# EasyEDA Pro project 3SE_24_Power_Rune.eprj, board Armour (continued)
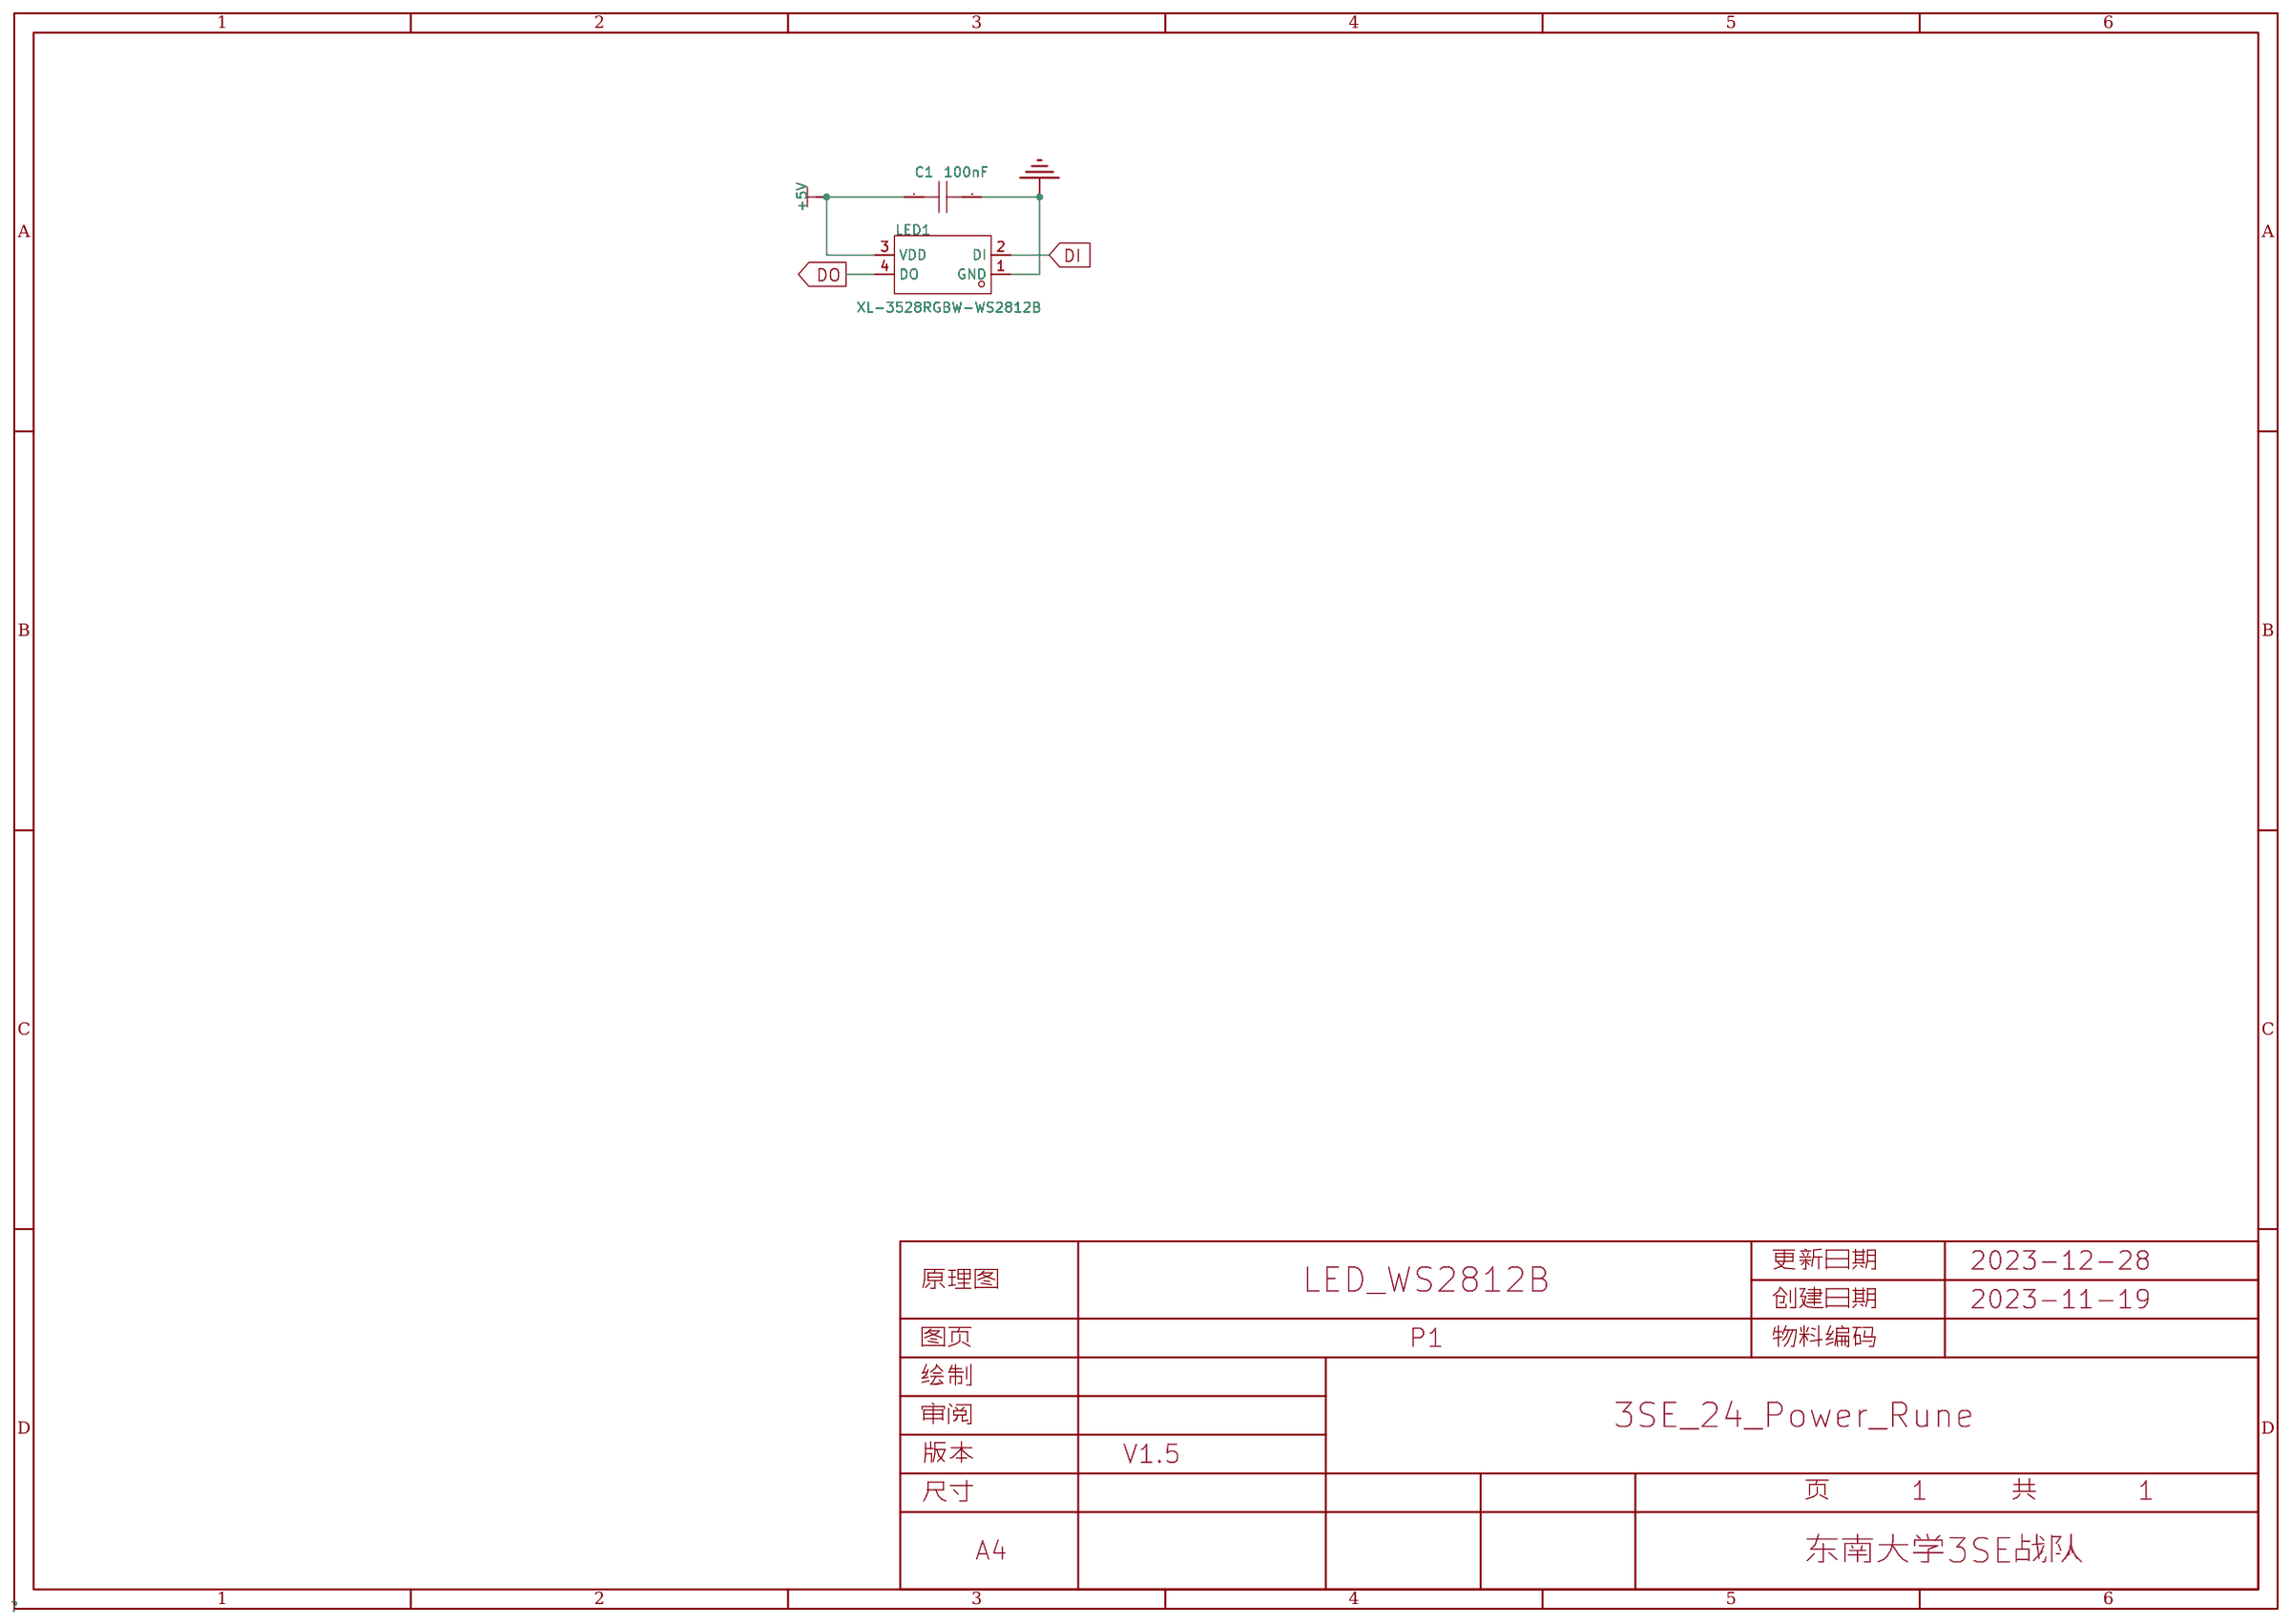
[diagram p0: schematic sheet]
## Placement (name value [footprint] x y rotation side) (continued)
C438  33nF  [C0603]  33.49 215.81 270 top
C439  100nF  [C0603]  331.91 201.18 270 top
C440  10uF  [C0603]  330.18 201.18 90 top
C441  100nF  [C0603]  352.22 233.9 180 top
C442  100nF  [C0603]  352.24 232.23 180 top
C443  100nF  [C0603]  279.05 249.36 0 top
C444  100nF  [C0603]  285.28 224.05 0 top
C445  1uF  [C0603]  328.78 234.88 90 top
C446  100nF  [C0603]  330.47 234.89 90 top
C447  100nF  [C0603]  248.04 239.71 0 top
C448  100nF  [C0603]  335.66 198 180 top
C449  100nF  [C0603]  247.69 235.59 90 top
C450  1uF  [C0603]  327.06 232.06 90 top
C451  100nF  [C0603]  225.74 219.96 0 top
C452  12pF  [C0603]  327.94 226.62 180 top
C453  100nF  [C0603]  213.56 205.44 0 top
C454  12pF  [C0603]  328.85 223.46 270 top
C456  100nF  [C0603]  212.46 187.33 0 top
C457  100nF  [C0603]  185.01 186.73 0 top
C458  -  [C0603]  48.33 77 108.9 top
C459  -  [C0603]  43.47 91.19 108.9 top
C460  -  [C0603]  38.61 105.38 108.9 top
C461  -  [C0603]  33.76 119.57 108.9 top
C462  -  [C0603]  28.9 133.77 108.9 top
C463  -  [C0603]  24.04 147.96 108.9 top
CN1  XT30PW-M  [CONN-TH_XT30PW-M]  24.01 241.31 270 top
CN2  SM03B-GHS-TB(LF)(SN)  [CONN-TH_SM03B-GHS-TB-LF-SN]  349.04 32.76 11 top
CN3  SM03B-GHS-TB(LF)(SN)  [CONN-TH_SM03B-GHS-TB-LF-SN#2]  22.46 32.76 349 top
CN4  HC-GH-2PWT  [CONN-SMD_2P-P1.25_HCTL_HC-GH-2PWTKK]  201.97 3.81 0 top
CN5  XT30PW-F  [CONN-TH_XT30PW-F-1]  185.75 9.26 0 top
CN6  WAFER-GH1.25-4PWB  [CONN-SMD_4P-P1.25_XUNPU_WAFER-GH1.25-4PWB]  350.11 249.29 90 top
D1  ESDBM24VD3  [SOD-323_L1.7-W1.3-LS2.6-BI]  32.75 242.05 270 top
D2  SB1045L  [TO-277_3P-L5.4-W4.0-LS6.5-TR]  33.78 222.79 0 top
D3  SMBJ6.0CA  [SMB_L4.6-W3.6-LS5.3-BI]  39.18 171.06 90 top
D4  USBLC6-2SC6  [SOT-23-6_L2.9-W1.6-P0.95-LS2.8-BL]  344 207.28 90 top
KEY1  -  [热插拔轴座]  185.75 196.24 0 top
KEY2  -  [热插拔轴座]  169.84 212.15 315 top
KEY3  -  [热插拔轴座]  201.66 180.33 135 top
KEY4  -  [热插拔轴座]  212.27 222.75 45 top
KEY5  -  [热插拔轴座]  159.23 222.75 135 top
KEY6  -  [热插拔轴座]  159.23 169.72 225 top
KEY7  -  [热插拔轴座]  212.27 169.72 315 top
KEY8  -  [热插拔轴座]  222.87 233.36 225 top
KEY9  -  [热插拔轴座]  148.63 233.36 315 top
KEY10  -  [热插拔轴座]  148.63 159.11 45 top
KEY11  -  [热插拔轴座]  222.87 159.11 135 top
KEY12  -  [热插拔轴座]  233.48 243.96 45 top
KEY13  -  [热插拔轴座]  138.02 243.96 135 top
KEY14  -  [热插拔轴座]  138.02 148.51 225 top
KEY15  -  [热插拔轴座]  233.48 148.51 315 top
KEY16  -  [热插拔轴座]  244.09 254.57 225 top
KEY17  -  [热插拔轴座]  127.41 254.57 315 top
KEY18  -  [热插拔轴座]  127.41 137.9 45 top
KEY19  -  [热插拔轴座]  244.09 137.9 135 top
KEY20  -  [热插拔轴座]  275.83 233.55 22.5 top
KEY21  -  [热插拔轴座]  223.06 286.31 67.5 top
KEY22  -  [热插拔轴座]  148.44 286.31 112.5 top
KEY23  -  [热插拔轴座]  95.67 233.55 157.5 top
KEY24  -  [热插拔轴座]  95.67 158.92 202.5 top
KEY25  -  [热插拔轴座]  148.44 106.16 247.5 top
KEY26  -  [热插拔轴座]  223.06 106.16 292.5 top
KEY27  -  [热插拔轴座]  275.83 158.92 337.5 top
KEY28  -  [热插拔轴座]  289.69 239.29 202.5 top
KEY29  -  [热插拔轴座]  228.8 300.17 247.5 top
KEY30  -  [热插拔轴座]  142.7 300.17 292.5 top
KEY31  -  [热插拔轴座]  81.81 239.29 337.5 top
KEY32  -  [热插拔轴座]  81.81 153.18 22.5 top
KEY33  -  [热插拔轴座]  142.7 92.3 67.5 top
KEY34  -  [热插拔轴座]  228.8 92.3 112.5 top
KEY35  -  [热插拔轴座]  289.69 153.18 157.5 top
KEY36  -  [热插拔轴座]  303.54 245.03 22.5 top
KEY37  -  [热插拔轴座]  234.54 314.03 67.5 top
KEY38  -  [热插拔轴座]  136.96 314.03 112.5 top
KEY39  -  [热插拔轴座]  67.89 245.03 157.5 top
KEY40  -  [热插拔轴座]  67.95 147.44 202.5 top
KEY41  -  [热插拔轴座]  136.96 78.44 247.5 top
KEY42  -  [热插拔轴座]  234.54 78.44 292.5 top
KEY43  -  [热插拔轴座]  303.54 147.44 337.5 top
KEY44  -  [热插拔轴座]  317.4 250.77 202.5 top
KEY45  -  [热插拔轴座]  240.28 327.89 247.5 top
KEY46  -  [热插拔轴座]  131.22 327.89 292.5 top
KEY47  -  [热插拔轴座]  54.1 250.77 337.5 top
KEY48  -  [热插拔轴座]  54.1 141.7 22.5 top
KEY49  -  [热插拔轴座]  131.22 64.58 67.5 top
KEY50  -  [热插拔轴座]  240.28 64.58 112.5 top
KEY51  -  [热插拔轴座]  317.4 141.7 157.5 top
L1  47uH  [IND-SMD_L17.5-W17.2]  28.94 188.5 0 top
LED1  -  [LED-SMD_4P-L3.5-W2.8-BR-1]  328.25 196.24 0 top
LED2  -  [LED-SMD_4P-L3.5-W2.8-BR-1]  327.03 214.84 0 top
LED3  -  [LED-SMD_4P-L3.5-W2.8-BR-1]  323.39 233.12 0 top
LED4  -  [LED-SMD_4P-L3.5-W2.8-BR-1]  309.16 267.49 0 top
LED5  -  [LED-SMD_4P-L3.5-W2.8-BR-1]  298.8 282.98 0 top
LED6  -  [LED-SMD_4P-L3.5-W2.8-BR-1]  286.51 297 0 top
LED7  -  [LED-SMD_4P-L3.5-W2.8-BR-1]  272.5 309.29 0 top
LED8  -  [LED-SMD_4P-L3.5-W2.8-BR-1]  257 319.64 0 top
LED9  -  [LED-SMD_4P-L3.5-W2.8-BR-1]  222.63 333.88 0 top
LED10  -  [LED-SMD_4P-L3.5-W2.8-BR-1]  204.35 337.52 0 top
LED11  -  [LED-SMD_4P-L3.5-W2.8-BR-1]  185.75 338.74 0 top
LED12  -  [LED-SMD_4P-L3.5-W2.8-BR-1]  167.15 337.52 0 top
LED13  -  [LED-SMD_4P-L3.5-W2.8-BR-1]  148.87 333.88 0 top
LED14  -  [LED-SMD_4P-L3.5-W2.8-BR-1]  114.5 319.64 0 top
LED15  -  [LED-SMD_4P-L3.5-W2.8-BR-1]  99 309.29 0 top
LED16  -  [LED-SMD_4P-L3.5-W2.8-BR-1]  84.99 297 0 top
LED17  -  [LED-SMD_4P-L3.5-W2.8-BR-1]  72.7 282.98 0 top
LED18  -  [LED-SMD_4P-L3.5-W2.8-BR-1]  62.34 267.49 0 top
LED19  -  [LED-SMD_4P-L3.5-W2.8-BR-1]  48.1 233.12 0 top
LED20  -  [LED-SMD_4P-L3.5-W2.8-BR-1]  44.47 214.84 0 top
LED21  -  [LED-SMD_4P-L3.5-W2.8-BR-1]  43.25 196.24 0 top
LED22  -  [LED-SMD_4P-L3.5-W2.8-BR-1]  44.47 177.64 0 top
LED23  -  [LED-SMD_4P-L3.5-W2.8-BR-1]  48.1 159.35 0 top
LED24  -  [LED-SMD_4P-L3.5-W2.8-BR-1]  62.34 124.99 0 top
LED25  -  [LED-SMD_4P-L3.5-W2.8-BR-1]  72.7 109.49 0 top
LED26  -  [LED-SMD_4P-L3.5-W2.8-BR-1]  84.99 95.47 0 top
LED27  -  [LED-SMD_4P-L3.5-W2.8-BR-1]  99 83.18 0 top
LED28  -  [LED-SMD_4P-L3.5-W2.8-BR-1]  114.5 72.83 0 top
LED29  -  [LED-SMD_4P-L3.5-W2.8-BR-1]  148.87 58.59 0 top
LED30  -  [LED-SMD_4P-L3.5-W2.8-BR-1]  167.15 54.95 0 top
LED31  -  [LED-SMD_4P-L3.5-W2.8-BR-1]  185.75 53.74 0 top
LED32  -  [LED-SMD_4P-L3.5-W2.8-BR-1]  204.35 54.95 0 top
LED33  -  [LED-SMD_4P-L3.5-W2.8-BR-1]  222.63 58.59 0 top
LED34  -  [LED-SMD_4P-L3.5-W2.8-BR-1]  257 72.83 0 top
LED35  -  [LED-SMD_4P-L3.5-W2.8-BR-1]  272.5 83.18 0 top
LED36  -  [LED-SMD_4P-L3.5-W2.8-BR-1]  286.51 95.47 0 top
LED37  -  [LED-SMD_4P-L3.5-W2.8-BR-1]  298.8 109.49 0 top
LED38  -  [LED-SMD_4P-L3.5-W2.8-BR-1]  309.16 124.99 0 top
LED39  -  [LED-SMD_4P-L3.5-W2.8-BR-1]  323.39 159.35 0 top
LED40  -  [LED-SMD_4P-L3.5-W2.8-BR-1]  327.03 177.64 0 top
LED41  -  [LED-SMD_4P-L3.5-W2.8-BR-1]  313.35 196.25 0 top
LED42  -  [LED-SMD_4P-L3.5-W2.8-BR-1]  311.97 214.01 180 top
LED43  -  [LED-SMD_4P-L3.5-W2.8-BR-1]  308.31 231.38 0 top
LED44  -  [LED-SMD_4P-L3.5-W2.8-BR-1]  299.4 253.98 0 top
LED45  -  [LED-SMD_4P-L3.5-W2.8-BR-1]  293.88 263.8 0 top
LED46  -  [LED-SMD_4P-L3.5-W2.8-BR-1]  283.42 278.19 0 top
LED47  -  [LED-SMD_4P-L3.5-W2.8-BR-1]  271.06 290.99 0 top
LED48  -  [LED-SMD_4P-L3.5-W2.8-BR-1]  257.05 301.94 0 top
LED49  -  [LED-SMD_4P-L3.5-W2.8-BR-1]  243.54 309.87 180 top
LED50  -  [LED-SMD_4P-L3.5-W2.8-BR-1]  225.28 317.49 0 top
LED51  -  [LED-SMD_4P-L3.5-W2.8-BR-1]  207.89 321.8 0 top
LED52  -  [LED-SMD_4P-L3.5-W2.8-BR-1]  190.2 323.66 0 top
LED53  -  [LED-SMD_4P-L3.5-W2.8-BR-1]  172.42 323.04 0 top
LED54  -  [LED-SMD_4P-L3.5-W2.8-BR-1]  154.22 319.34 0 top
LED55  -  [LED-SMD_4P-L3.5-W2.8-BR-1]  122 306.65 0 top
LED56  -  [LED-SMD_4P-L3.5-W2.8-BR-1]  107.25 296.71 0 top
LED57  -  [LED-SMD_4P-L3.5-W2.8-BR-1]  94.03 284.8 0 top
LED58  -  [LED-SMD_4P-L3.5-W2.8-BR-1]  82.6 271.18 0 top
LED59  -  [LED-SMD_4P-L3.5-W2.8-BR-1]  73.17 256.09 0 top
LED60  -  [LED-SMD_4P-L3.5-W2.8-BR-1]  64.73 236.35 180 top
LED61  -  [LED-SMD_4P-L3.5-W2.8-BR-1]  61.04 222.74 0 top
LED62  -  [LED-SMD_4P-L3.5-W2.8-BR-1]  58.56 205.13 0 top
LED63  -  [LED-SMD_4P-L3.5-W2.8-BR-1]  58.56 187.34 0 top
LED64  -  [LED-SMD_4P-L3.5-W2.8-BR-1]  61.04 169.73 0 top
LED65  -  [LED-SMD_4P-L3.5-W2.8-BR-1]  64.57 156.67 0 top
LED66  -  [LED-SMD_4P-L3.5-W2.8-BR-1]  73.17 136.38 0 top
LED67  -  [LED-SMD_4P-L3.5-W2.8-BR-1]  82.6 121.29 0 top
LED68  -  [LED-SMD_4P-L3.5-W2.8-BR-1]  94.03 107.67 0 top
LED69  -  [LED-SMD_4P-L3.5-W2.8-BR-1]  106.42 96.66 0 top
LED70  -  [LED-SMD_4P-L3.5-W2.8-BR-1]  122 85.82 0 top
LED71  -  [LED-SMD_4P-L3.5-W2.8-BR-1]  154.9 72.52 0 top
LED72  -  [LED-SMD_4P-L3.5-W2.8-BR-1]  172.42 69.43 0 top
LED73  -  [LED-SMD_4P-L3.5-W2.8-BR-1]  190.2 68.81 0 top
LED74  -  [LED-SMD_4P-L3.5-W2.8-BR-1]  207.89 70.67 0 top
LED75  -  [LED-SMD_4P-L3.5-W2.8-BR-1]  225.4 75.1 180 top
LED76  -  [LED-SMD_4P-L3.5-W2.8-BR-1]  243.46 82.52 0 top
LED77  -  [LED-SMD_4P-L3.5-W2.8-BR-1]  257.05 90.53 0 top
LED78  -  [LED-SMD_4P-L3.5-W2.8-BR-1]  271.06 101.48 0 top
LED79  -  [LED-SMD_4P-L3.5-W2.8-BR-1]  282.4 112.64 0 top
LED80  -  [LED-SMD_4P-L3.5-W2.8-BR-1]  293.88 128.67 0 top
LED81  -  [LED-SMD_4P-L3.5-W2.8-BR-1]  308.31 161.09 0 top
LED82  -  [LED-SMD_4P-L3.5-W2.8-BR-1]  312.01 178.49 0 top
LED83  -  [LED-SMD_4P-L3.5-W2.8-BR-1]  298.25 196.24 0 top
LED84  -  [LED-SMD_4P-L3.5-W2.8-BR-1]  296.86 213.83 0 top
LED85  -  [LED-SMD_4P-L3.5-W2.8-BR-1]  292.96 230.25 180 top
LED86  -  [LED-SMD_4P-L3.5-W2.8-BR-1]  285.48 248.31 0 top
LED87  -  [LED-SMD_4P-L3.5-W2.8-BR-1]  276.76 262.36 0 top
LED88  -  [LED-SMD_4P-L3.5-W2.8-BR-1]  265.3 275.78 0 top
LED89  -  [LED-SMD_4P-L3.5-W2.8-BR-1]  251.88 287.25 0 top
LED90  -  [LED-SMD_4P-L3.5-W2.8-BR-1]  237.81 295.96 180 top
LED91  -  [LED-SMD_4P-L3.5-W2.8-BR-1]  219.22 303.66 0 top
LED92  -  [LED-SMD_4P-L3.5-W2.8-BR-1]  203.35 307.35 0 top
LED93  -  [LED-SMD_4P-L3.5-W2.8-BR-1]  185.75 308.74 0 top
LED94  -  [LED-SMD_4P-L3.5-W2.8-BR-1]  168.15 307.35 0 top
LED95  -  [LED-SMD_4P-L3.5-W2.8-BR-1]  151.81 303.5 0 top
LED96  -  [LED-SMD_4P-L3.5-W2.8-BR-1]  133.78 296 180 top
LED97  -  [LED-SMD_4P-L3.5-W2.8-BR-1]  119.62 287.25 0 top
LED98  -  [LED-SMD_4P-L3.5-W2.8-BR-1]  106.2 275.78 0 top
LED99  -  [LED-SMD_4P-L3.5-W2.8-BR-1]  94.73 262.36 0 top
LED100  -  [LED-SMD_4P-L3.5-W2.8-BR-1]  85.82 247.86 0 top
LED101  -  [LED-SMD_4P-L3.5-W2.8-BR-1]  78.6 230.39 180 top
LED102  -  [LED-SMD_4P-L3.5-W2.8-BR-1]  74.63 213.83 0 top
LED103  -  [LED-SMD_4P-L3.5-W2.8-BR-1]  73.25 196.24 0 top
LED104  -  [LED-SMD_4P-L3.5-W2.8-BR-1]  74.63 178.64 0 top
LED105  -  [LED-SMD_4P-L3.5-W2.8-BR-1]  78.4 162.54 0 top
LED106  -  [LED-SMD_4P-L3.5-W2.8-BR-1]  85.92 144.32 180 top
LED107  -  [LED-SMD_4P-L3.5-W2.8-BR-1]  94.73 130.11 0 top
LED108  -  [LED-SMD_4P-L3.5-W2.8-BR-1]  106.2 116.69 0 top
LED109  -  [LED-SMD_4P-L3.5-W2.8-BR-1]  119.62 105.22 0 top
LED110  -  [LED-SMD_4P-L3.5-W2.8-BR-1]  133.36 96.62 0 top
LED111  -  [LED-SMD_4P-L3.5-W2.8-BR-1]  152 88.9 180 top
LED112  -  [LED-SMD_4P-L3.5-W2.8-BR-1]  168.15 85.12 0 top
LED113  -  [LED-SMD_4P-L3.5-W2.8-BR-1]  185.75 83.74 0 top
LED114  -  [LED-SMD_4P-L3.5-W2.8-BR-1]  203.35 85.12 0 top
LED115  -  [LED-SMD_4P-L3.5-W2.8-BR-1]  219.4 88.9 180 top
LED116  -  [LED-SMD_4P-L3.5-W2.8-BR-1]  237.71 96.46 0 top
LED117  -  [LED-SMD_4P-L3.5-W2.8-BR-1]  251.88 105.22 0 top
LED118  -  [LED-SMD_4P-L3.5-W2.8-BR-1]  265.3 116.69 0 top
LED119  -  [LED-SMD_4P-L3.5-W2.8-BR-1]  276.76 130.11 0 top
LED120  -  [LED-SMD_4P-L3.5-W2.8-BR-1]  285.68 144.42 180 top
LED121  -  [LED-SMD_4P-L3.5-W2.8-BR-1]  292.97 162.1 0 top
LED122  -  [LED-SMD_4P-L3.5-W2.8-BR-1]  296.86 178.64 0 top
LED123  -  [LED-SMD_4P-L3.5-W2.8-BR-1]  283.25 196.24 0 top
LED124  -  [LED-SMD_4P-L3.5-W2.8-BR-1]  281.77 213.17 0 top
LED125  -  [LED-SMD_4P-L3.5-W2.8-BR-1]  279.08 224.27 180 top
LED126  -  [LED-SMD_4P-L3.5-W2.8-BR-1]  270.19 244.99 0 top
LED127  -  [LED-SMD_4P-L3.5-W2.8-BR-1]  260.44 258.91 0 top
LED128  -  [LED-SMD_4P-L3.5-W2.8-BR-1]  248.42 270.92 0 top
LED129  -  [LED-SMD_4P-L3.5-W2.8-BR-1]  234.5 280.67 0 top
LED130  -  [LED-SMD_4P-L3.5-W2.8-BR-1]  213.42 289.73 0 top
LED131  -  [LED-SMD_4P-L3.5-W2.8-BR-1]  202.68 292.25 0 top
LED132  -  [LED-SMD_4P-L3.5-W2.8-BR-1]  185.75 293.74 0 top
LED133  -  [LED-SMD_4P-L3.5-W2.8-BR-1]  168.82 292.25 0 top
LED134  -  [LED-SMD_4P-L3.5-W2.8-BR-1]  158.14 289.56 0 top
LED135  -  [LED-SMD_4P-L3.5-W2.8-BR-1]  137 280.67 0 top
LED136  -  [LED-SMD_4P-L3.5-W2.8-BR-1]  123.08 270.92 0 top
LED137  -  [LED-SMD_4P-L3.5-W2.8-BR-1]  111.06 258.91 0 top
LED138  -  [LED-SMD_4P-L3.5-W2.8-BR-1]  101.31 244.99 0 top
LED139  -  [LED-SMD_4P-L3.5-W2.8-BR-1]  92.47 224.54 180 top
LED140  -  [LED-SMD_4P-L3.5-W2.8-BR-1]  89.73 213.17 0 top
LED141  -  [LED-SMD_4P-L3.5-W2.8-BR-1]  88.25 196.24 0 top
LED142  -  [LED-SMD_4P-L3.5-W2.8-BR-1]  89.73 179.3 0 top
LED143  -  [LED-SMD_4P-L3.5-W2.8-BR-1]  92.3 168.4 0 top
LED144  -  [LED-SMD_4P-L3.5-W2.8-BR-1]  101.31 147.49 0 top
LED145  -  [LED-SMD_4P-L3.5-W2.8-BR-1]  111.06 133.56 0 top
LED146  -  [LED-SMD_4P-L3.5-W2.8-BR-1]  123.08 121.55 0 top
LED147  -  [LED-SMD_4P-L3.5-W2.8-BR-1]  137 111.8 0 top
LED148  -  [LED-SMD_4P-L3.5-W2.8-BR-1]  157.83 102.79 180 top
LED149  -  [LED-SMD_4P-L3.5-W2.8-BR-1]  168.82 100.22 0 top
LED150  -  [LED-SMD_4P-L3.5-W2.8-BR-1]  185.75 98.74 0 top
LED151  -  [LED-SMD_4P-L3.5-W2.8-BR-1]  202.68 100.22 0 top
LED152  -  [LED-SMD_4P-L3.5-W2.8-BR-1]  213.73 102.86 180 top
LED153  -  [LED-SMD_4P-L3.5-W2.8-BR-1]  234.5 111.8 0 top
LED154  -  [LED-SMD_4P-L3.5-W2.8-BR-1]  248.42 121.55 0 top
LED155  -  [LED-SMD_4P-L3.5-W2.8-BR-1]  260.44 133.56 0 top
LED156  -  [LED-SMD_4P-L3.5-W2.8-BR-1]  270.19 147.49 0 top
LED157  -  [LED-SMD_4P-L3.5-W2.8-BR-1]  279.06 167.9 0 top
LED158  -  [LED-SMD_4P-L3.5-W2.8-BR-1]  281.77 179.3 0 top
LED159  -  [LED-SMD_4P-L3.5-W2.8-BR-1]  268.25 196.24 0 top
LED160  -  [LED-SMD_4P-L3.5-W2.8-BR-1]  267 210.56 0 top
LED161  -  [LED-SMD_4P-L3.5-W2.8-BR-1]  263.27 224.45 0 top
LED162  -  [LED-SMD_4P-L3.5-W2.8-BR-1]  257.2 237.49 0 top
LED163  -  [LED-SMD_4P-L3.5-W2.8-BR-1]  251.11 247.05 180 top
LED164  -  [LED-SMD_4P-L3.5-W2.8-BR-1]  236.34 261.48 0 top
LED165  -  [LED-SMD_4P-L3.5-W2.8-BR-1]  227 267.68 0 top
LED166  -  [LED-SMD_4P-L3.5-W2.8-BR-1]  213.97 273.76 0 top
LED167  -  [LED-SMD_4P-L3.5-W2.8-BR-1]  200.08 277.48 0 top
LED168  -  [LED-SMD_4P-L3.5-W2.8-BR-1]  185.75 278.74 0 top
LED169  -  [LED-SMD_4P-L3.5-W2.8-BR-1]  171.42 277.48 0 top
LED170  -  [LED-SMD_4P-L3.5-W2.8-BR-1]  157.53 273.76 0 top
LED171  -  [LED-SMD_4P-L3.5-W2.8-BR-1]  144.5 267.68 0 top
LED172  -  [LED-SMD_4P-L3.5-W2.8-BR-1]  135 260.85 0 top
LED173  -  [LED-SMD_4P-L3.5-W2.8-BR-1]  120.14 247.53 180 top
LED174  -  [LED-SMD_4P-L3.5-W2.8-BR-1]  114.3 237.49 0 top
LED175  -  [LED-SMD_4P-L3.5-W2.8-BR-1]  108.22 224.45 0 top
LED176  -  [LED-SMD_4P-L3.5-W2.8-BR-1]  104.5 210.56 0 top
LED177  -  [LED-SMD_4P-L3.5-W2.8-BR-1]  103.25 196.24 0 top
LED178  -  [LED-SMD_4P-L3.5-W2.8-BR-1]  104.5 181.91 0 top
LED179  -  [LED-SMD_4P-L3.5-W2.8-BR-1]  108.22 168.02 0 top
LED180  -  [LED-SMD_4P-L3.5-W2.8-BR-1]  114.3 154.99 0 top
LED181  -  [LED-SMD_4P-L3.5-W2.8-BR-1]  120.27 145.38 0 top
LED182  -  [LED-SMD_4P-L3.5-W2.8-BR-1]  135.01 131.14 180 top
LED183  -  [LED-SMD_4P-L3.5-W2.8-BR-1]  144.5 124.79 0 top
LED184  -  [LED-SMD_4P-L3.5-W2.8-BR-1]  157.53 118.71 0 top
LED185  -  [LED-SMD_4P-L3.5-W2.8-BR-1]  171.42 114.99 0 top
LED186  -  [LED-SMD_4P-L3.5-W2.8-BR-1]  185.75 113.74 0 top
LED187  -  [LED-SMD_4P-L3.5-W2.8-BR-1]  200.08 114.99 0 top
LED188  -  [LED-SMD_4P-L3.5-W2.8-BR-1]  213.97 118.71 0 top
LED189  -  [LED-SMD_4P-L3.5-W2.8-BR-1]  227 124.79 0 top
LED190  -  [LED-SMD_4P-L3.5-W2.8-BR-1]  237.11 131.06 180 top
LED191  -  [LED-SMD_4P-L3.5-W2.8-BR-1]  251.23 144.69 0 top
LED192  -  [LED-SMD_4P-L3.5-W2.8-BR-1]  257.2 154.99 0 top
LED193  -  [LED-SMD_4P-L3.5-W2.8-BR-1]  263.27 168.02 0 top
LED194  -  [LED-SMD_4P-L3.5-W2.8-BR-1]  267 181.91 0 top
LED195  -  [LED-SMD_4P-L3.5-W2.8-BR-1]  253.25 196.24 0 top
LED196  -  [LED-SMD_4P-L3.5-W2.8-BR-1]  250.95 213.71 0 top
LED197  -  [LED-SMD_4P-L3.5-W2.8-BR-1]  244.21 229.99 0 top
LED198  -  [LED-SMD_4P-L3.5-W2.8-BR-1]  219.5 254.69 0 top
LED199  -  [LED-SMD_4P-L3.5-W2.8-BR-1]  203.22 261.44 0 top
LED200  -  [LED-SMD_4P-L3.5-W2.8-BR-1]  185.75 263.74 0 top
LED201  -  [LED-SMD_4P-L3.5-W2.8-BR-1]  168.28 261.44 0 top
LED202  -  [LED-SMD_4P-L3.5-W2.8-BR-1]  152 254.69 0 top
LED203  -  [LED-SMD_4P-L3.5-W2.8-BR-1]  127.29 229.99 0 top
LED204  -  [LED-SMD_4P-L3.5-W2.8-BR-1]  120.55 213.71 0 top
LED205  -  [LED-SMD_4P-L3.5-W2.8-BR-1]  118.25 196.24 0 top
LED206  -  [LED-SMD_4P-L3.5-W2.8-BR-1]  120.55 178.76 0 top
LED207  -  [LED-SMD_4P-L3.5-W2.8-BR-1]  127.29 162.49 0 top
LED208  -  [LED-SMD_4P-L3.5-W2.8-BR-1]  152 137.78 0 top
LED209  -  [LED-SMD_4P-L3.5-W2.8-BR-1]  168.28 131.04 0 top
LED210  -  [LED-SMD_4P-L3.5-W2.8-BR-1]  185.75 128.74 0 top
LED211  -  [LED-SMD_4P-L3.5-W2.8-BR-1]  203.22 131.04 0 top
LED212  -  [LED-SMD_4P-L3.5-W2.8-BR-1]  219.5 137.78 0 top
LED213  -  [LED-SMD_4P-L3.5-W2.8-BR-1]  244.21 162.49 0 top
LED214  -  [LED-SMD_4P-L3.5-W2.8-BR-1]  250.95 178.76 0 top
LED215  -  [LED-SMD_4P-L3.5-W2.8-BR-1]  238.25 196.24 0 top
LED216  -  [LED-SMD_4P-L3.5-W2.8-BR-1]  236.46 209.82 0 top
LED217  -  [LED-SMD_4P-L3.5-W2.8-BR-1]  231.22 222.49 0 top
LED218  -  [LED-SMD_4P-L3.5-W2.8-BR-1]  212 241.7 0 top
LED219  -  [LED-SMD_4P-L3.5-W2.8-BR-1]  199.34 246.95 0 top
LED220  -  [LED-SMD_4P-L3.5-W2.8-BR-1]  185.75 248.74 0 top
LED221  -  [LED-SMD_4P-L3.5-W2.8-BR-1]  172.16 246.95 0 top
LED222  -  [LED-SMD_4P-L3.5-W2.8-BR-1]  158.97 241.13 0 top
LED223  -  [LED-SMD_4P-L3.5-W2.8-BR-1]  140.28 222.49 0 top
LED224  -  [LED-SMD_4P-L3.5-W2.8-BR-1]  135.04 209.82 0 top
LED225  -  [LED-SMD_4P-L3.5-W2.8-BR-1]  133.25 196.24 0 top
LED226  -  [LED-SMD_4P-L3.5-W2.8-BR-1]  135.04 182.65 0 top
LED227  -  [LED-SMD_4P-L3.5-W2.8-BR-1]  140.28 169.99 0 top
LED228  -  [LED-SMD_4P-L3.5-W2.8-BR-1]  157.32 150.97 0 top
LED229  -  [LED-SMD_4P-L3.5-W2.8-BR-1]  172.16 145.52 0 top
LED230  -  [LED-SMD_4P-L3.5-W2.8-BR-1]  185.75 143.74 0 top
LED231  -  [LED-SMD_4P-L3.5-W2.8-BR-1]  199.34 145.52 0 top
LED232  -  [LED-SMD_4P-L3.5-W2.8-BR-1]  212 150.77 0 top
LED233  -  [LED-SMD_4P-L3.5-W2.8-BR-1]  231.22 169.99 0 top
LED234  -  [LED-SMD_4P-L3.5-W2.8-BR-1]  236.46 182.65 0 top
LED235  -  [LED-SMD_4P-L3.5-W2.8-BR-1]  223.25 196.24 0 top
LED236  -  [LED-SMD_4P-L3.5-W2.8-BR-1]  218.84 214.69 180 top
LED237  -  [LED-SMD_4P-L3.5-W2.8-BR-1]  204.14 228.92 0 top
LED238  -  [LED-SMD_4P-L3.5-W2.8-BR-1]  185.75 233.74 0 top
LED239  -  [LED-SMD_4P-L3.5-W2.8-BR-1]  167 228.71 0 top
LED240  -  [LED-SMD_4P-L3.5-W2.8-BR-1]  152.93 215.19 180 top
LED241  -  [LED-SMD_4P-L3.5-W2.8-BR-1]  148.25 196.27 180 top
LED242  -  [LED-SMD_4P-L3.5-W2.8-BR-1]  153 177.75 0 top
LED243  -  [LED-SMD_4P-L3.5-W2.8-BR-1]  167.61 163.51 180 top
LED244  -  [LED-SMD_4P-L3.5-W2.8-BR-1]  185.75 158.74 0 top
LED245  -  [LED-SMD_4P-L3.5-W2.8-BR-1]  204.34 163.39 180 top
LED246  -  [LED-SMD_4P-L3.5-W2.8-BR-1]  218.23 177.49 0 top
LED247  -  [LED-SMD_4P-L3.5-W2.8-BR-1]  208.25 196.24 0 top
LED248  -  [LED-SMD_4P-L3.5-W2.8-BR-1]  205.24 207.49 0 top
LED249  -  [LED-SMD_4P-L3.5-W2.8-BR-1]  197 215.72 0 top
LED250  -  [LED-SMD_4P-L3.5-W2.8-BR-1]  185.75 218.74 0 top
LED251  -  [LED-SMD_4P-L3.5-W2.8-BR-1]  163.22 196.23 180 top
LED252  -  [LED-SMD_4P-L3.5-W2.8-BR-1]  166.26 184.99 0 top
LED253  -  [LED-SMD_4P-L3.5-W2.8-BR-1]  174.5 176.75 0 top
LED254  -  [LED-SMD_4P-L3.5-W2.8-BR-1]  185.75 173.74 0 top
LED255  -  [LED-SMD_4P-L3.5-W2.8-BR-1]  185.75 183.94 180 top
LED256  -  [LED-SMD_4P-L3.5-W2.8-BR-1]  197.88 196.24 0 top
LED257  -  [LED-SMD_4P-L3.5-W2.8-BR-1]  185.75 208.54 0 top
LED258  -  [LED-SMD_4P-L3.5-W2.8-BR-1]  173.46 196.22 180 top
LED259  -  [LED-SMD_4P-L3.5-W2.8-BR-1]  335.66 263.81 99.4 top
LED260  -  [LED-SMD_4P-L3.5-W2.8-BR-1]  333.22 278.61 99.4 top
LED261  -  [LED-SMD_4P-L3.5-W2.8-BR-1]  330.77 293.41 99.4 top
LED262  -  [LED-SMD_4P-L3.5-W2.8-BR-1]  327.74 311.01 99.4 top
LED263  -  [LED-SMD_4P-L3.5-W2.8-BR-1]  325.88 323 99.4 top
LED264  -  [LED-SMD_4P-L3.5-W2.8-BR-1]  345.53 265.44 99.4 top
LED265  -  [LED-SMD_4P-L3.5-W2.8-BR-1]  343.08 280.24 99.4 top
LED266  -  [LED-SMD_4P-L3.5-W2.8-BR-1]  340.64 295.04 99.4 top
LED267  -  [LED-SMD_4P-L3.5-W2.8-BR-1]  338.19 309.84 99.4 top
LED268  -  [LED-SMD_4P-L3.5-W2.8-BR-1]  335.75 324.63 99.4 top
LED269  -  [LED-SMD_4P-L3.5-W2.8-BR-1]  319.47 331.59 162.8 top
LED270  -  [LED-SMD_4P-L3.5-W2.8-BR-1]  310.85 335.37 162.8 top
LED271  -  [LED-SMD_4P-L3.5-W2.8-BR-1]  297.48 339.51 162.8 top
LED272  -  [LED-SMD_4P-L3.5-W2.8-BR-1]  284.1 343.66 162.8 top
LED273  -  [LED-SMD_4P-L3.5-W2.8-BR-1]  270.73 347.81 162.8 top
LED274  -  [LED-SMD_4P-L3.5-W2.8-BR-1]  257.36 351.96 162.8 top
LED275  -  [LED-SMD_4P-L3.5-W2.8-BR-1]  243.99 356.11 162.8 top
LED276  -  [LED-SMD_4P-L3.5-W2.8-BR-1]  230.62 360.25 162.8 top
LED277  -  [LED-SMD_4P-L3.5-W2.8-BR-1]  328.61 338.5 162.8 top
LED278  -  [LED-SMD_4P-L3.5-W2.8-BR-1]  313.81 344.92 162.8 top
LED279  -  [LED-SMD_4P-L3.5-W2.8-BR-1]  300.44 349.06 162.8 top
LED280  -  [LED-SMD_4P-L3.5-W2.8-BR-1]  287.07 353.21 162.8 top
LED281  -  [LED-SMD_4P-L3.5-W2.8-BR-1]  273.7 357.36 162.8 top
LED282  -  [LED-SMD_4P-L3.5-W2.8-BR-1]  260.32 361.51 162.8 top
LED283  -  [LED-SMD_4P-L3.5-W2.8-BR-1]  246.95 365.66 162.8 top
LED284  -  [LED-SMD_4P-L3.5-W2.8-BR-1]  233.58 369.81 162.8 top
LED285  -  [LED-SMD_4P-L3.5-W2.8-BR-1]  332.81 349.44 162.8 top
LED286  -  [LED-SMD_4P-L3.5-W2.8-BR-1]  316.77 354.47 162.8 top
LED287  -  [LED-SMD_4P-L3.5-W2.8-BR-1]  303.4 358.62 162.8 top
LED288  -  [LED-SMD_4P-L3.5-W2.8-BR-1]  290.03 362.76 162.8 top
LED289  -  [LED-SMD_4P-L3.5-W2.8-BR-1]  276.66 366.91 162.8 top
LED290  -  [LED-SMD_4P-L3.5-W2.8-BR-1]  263.29 371.06 162.8 top
LED291  -  [LED-SMD_4P-L3.5-W2.8-BR-1]  249.92 375.21 162.8 top
LED292  -  [LED-SMD_4P-L3.5-W2.8-BR-1]  236.55 379.36 162.8 top
LED293  -  [LED-SMD_4P-L3.5-W2.8-BR-1]  220.88 361.63 180 top
LED294  -  [LED-SMD_4P-L3.5-W2.8-BR-1]  206.88 361.63 180 top
LED295  -  [LED-SMD_4P-L3.5-W2.8-BR-1]  192.88 361.63 180 top
LED296  -  [LED-SMD_4P-L3.5-W2.8-BR-1]  178.88 361.63 180 top
LED297  -  [LED-SMD_4P-L3.5-W2.8-BR-1]  164.88 361.63 180 top
LED298  -  [LED-SMD_4P-L3.5-W2.8-BR-1]  150.88 361.63 180 top
LED299  -  [LED-SMD_4P-L3.5-W2.8-BR-1]  220.88 371.63 180 top
LED300  -  [LED-SMD_4P-L3.5-W2.8-BR-1]  206.88 371.63 180 top
LED301  -  [LED-SMD_4P-L3.5-W2.8-BR-1]  192.88 371.63 180 top
LED302  -  [LED-SMD_4P-L3.5-W2.8-BR-1]  178.88 371.63 180 top
LED303  -  [LED-SMD_4P-L3.5-W2.8-BR-1]  164.88 371.63 180 top
LED304  -  [LED-SMD_4P-L3.5-W2.8-BR-1]  150.88 371.63 180 top
LED305  -  [LED-SMD_4P-L3.5-W2.8-BR-1]  220.88 381.63 180 top
LED306  -  [LED-SMD_4P-L3.5-W2.8-BR-1]  206.88 381.63 180 top
LED307  -  [LED-SMD_4P-L3.5-W2.8-BR-1]  192.88 381.63 180 top
LED308  -  [LED-SMD_4P-L3.5-W2.8-BR-1]  178.88 381.63 180 top
LED309  -  [LED-SMD_4P-L3.5-W2.8-BR-1]  164.88 381.63 180 top
LED310  -  [LED-SMD_4P-L3.5-W2.8-BR-1]  150.88 381.63 180 top
LED311  -  [LED-SMD_4P-L3.5-W2.8-BR-1]  139.77 359.25 196.2 top
LED312  -  [LED-SMD_4P-L3.5-W2.8-BR-1]  126.33 355.34 196.2 top
LED313  -  [LED-SMD_4P-L3.5-W2.8-BR-1]  112.89 351.43 196.2 top
LED314  -  [LED-SMD_4P-L3.5-W2.8-BR-1]  99.44 347.53 196.2 top
LED315  -  [LED-SMD_4P-L3.5-W2.8-BR-1]  86 343.62 196.2 top
LED316  -  [LED-SMD_4P-L3.5-W2.8-BR-1]  72.55 339.71 196.2 top
LED317  -  [LED-SMD_4P-L3.5-W2.8-BR-1]  59.11 335.8 196.2 top
LED318  -  [LED-SMD_4P-L3.5-W2.8-BR-1]  49.03 330.84 196.2 top
LED319  -  [LED-SMD_4P-L3.5-W2.8-BR-1]  136.98 368.85 196.2 top
LED320  -  [LED-SMD_4P-L3.5-W2.8-BR-1]  123.54 364.94 196.2 top
LED321  -  [LED-SMD_4P-L3.5-W2.8-BR-1]  110.09 361.03 196.2 top
LED322  -  [LED-SMD_4P-L3.5-W2.8-BR-1]  96.65 357.13 196.2 top
LED323  -  [LED-SMD_4P-L3.5-W2.8-BR-1]  83.21 353.22 196.2 top
LED324  -  [LED-SMD_4P-L3.5-W2.8-BR-1]  69.76 349.31 196.2 top
LED325  -  [LED-SMD_4P-L3.5-W2.8-BR-1]  56.32 345.41 196.2 top
LED326  -  [LED-SMD_4P-L3.5-W2.8-BR-1]  40.74 337.98 196.2 top
LED327  -  [LED-SMD_4P-L3.5-W2.8-BR-1]  134.19 378.45 196.2 top
LED328  -  [LED-SMD_4P-L3.5-W2.8-BR-1]  120.75 374.54 196.2 top
LED329  -  [LED-SMD_4P-L3.5-W2.8-BR-1]  107.3 370.64 196.2 top
LED330  -  [LED-SMD_4P-L3.5-W2.8-BR-1]  93.86 366.73 196.2 top
LED331  -  [LED-SMD_4P-L3.5-W2.8-BR-1]  80.42 362.82 196.2 top
LED332  -  [LED-SMD_4P-L3.5-W2.8-BR-1]  66.97 358.92 196.2 top
LED333  -  [LED-SMD_4P-L3.5-W2.8-BR-1]  53.53 355.01 196.2 top
LED334  -  [LED-SMD_4P-L3.5-W2.8-BR-1]  36.44 350.09 196.2 top
LED335  -  [LED-SMD_4P-L3.5-W2.8-BR-1]  46.13 319.82 259.5 top
LED336  -  [LED-SMD_4P-L3.5-W2.8-BR-1]  43.48 302.49 259.5 top
LED337  -  [LED-SMD_4P-L3.5-W2.8-BR-1]  40.69 290.32 259.5 top
LED338  -  [LED-SMD_4P-L3.5-W2.8-BR-1]  37.97 275.57 259.5 top
LED339  -  [LED-SMD_4P-L3.5-W2.8-BR-1]  35.25 260.82 259.5 top
LED340  -  [LED-SMD_4P-L3.5-W2.8-BR-1]  36.3 321.64 259.5 top
LED341  -  [LED-SMD_4P-L3.5-W2.8-BR-1]  33.58 306.89 259.5 top
LED342  -  [LED-SMD_4P-L3.5-W2.8-BR-1]  30.86 292.14 259.5 top
LED343  -  [LED-SMD_4P-L3.5-W2.8-BR-1]  28.14 277.38 259.5 top
LED344  -  [LED-SMD_4P-L3.5-W2.8-BR-1]  25.42 262.63 259.5 top
LED345  -  [LED-SMD_4P-L3.5-W2.8-BR-1]  346.67 148.38 249.8 top
LED346  -  [LED-SMD_4P-L3.5-W2.8-BR-1]  341.49 134.31 249.8 top
LED347  -  [LED-SMD_4P-L3.5-W2.8-BR-1]  336.31 120.23 249.8 top
LED348  -  [LED-SMD_4P-L3.5-W2.8-BR-1]  331.13 106.15 249.8 top
LED349  -  [LED-SMD_4P-L3.5-W2.8-BR-1]  325.95 92.08 249.8 top
LED350  -  [LED-SMD_4P-L3.5-W2.8-BR-1]  320.76 78 249.8 top
LED351  -  [LED-SMD_4P-L3.5-W2.8-BR-1]  341.97 96.97 249.1 top
LED352  -  [LED-SMD_4P-L3.5-W2.8-BR-1]  339.01 82.14 249.1 top
LED353  -  [LED-SMD_4P-L3.5-W2.8-BR-1]  331.28 68.94 249.1 top
LED354  -  [LED-SMD_4P-L3.5-W2.8-BR-1]  343.46 65.39 271 top
LED355  -  [LED-SMD_4P-L3.5-W2.8-BR-1]  357.05 64.57 92.5 top
LED356  -  [LED-SMD_4P-L3.5-W2.8-BR-1]  356.64 79.57 92.5 top
LED357  -  [LED-SMD_4P-L3.5-W2.8-BR-1]  356.23 94.56 92.5 top
LED358  -  [LED-SMD_4P-L3.5-W2.8-BR-1]  355.83 109.55 92.5 top
LED359  -  [LED-SMD_4P-L3.5-W2.8-BR-1]  355.42 124.54 92.5 top
LED360  -  [LED-SMD_4P-L3.5-W2.8-BR-1]  355.05 138.6 92.2 top
LED361  -  [LED-SMD_4P-L3.5-W2.8-BR-1]  337.75 38.25 191.3 top
LED362  -  [LED-SMD_4P-L3.5-W2.8-BR-1]  310.71 33.02 191.3 top
LED363  -  [LED-SMD_4P-L3.5-W2.8-BR-1]  296 30.08 191.3 top
LED364  -  [LED-SMD_4P-L3.5-W2.8-BR-1]  281.29 27.15 191.3 top
LED365  -  [LED-SMD_4P-L3.5-W2.8-BR-1]  266.58 24.22 191.3 top
LED366  -  [LED-SMD_4P-L3.5-W2.8-BR-1]  251.87 21.28 191.3 top
LED367  -  [LED-SMD_4P-L3.5-W2.8-BR-1]  237.16 18.35 191.3 top
LED368  -  [LED-SMD_4P-L3.5-W2.8-BR-1]  222.45 15.42 191.3 top
LED369  -  [LED-SMD_4P-L3.5-W2.8-BR-1]  326.55 46.6 191.3 top
LED370  -  [LED-SMD_4P-L3.5-W2.8-BR-1]  308.76 42.82 191.3 top
LED371  -  [LED-SMD_4P-L3.5-W2.8-BR-1]  294.05 39.89 191.3 top
LED372  -  [LED-SMD_4P-L3.5-W2.8-BR-1]  279.34 36.96 191.3 top
LED373  -  [LED-SMD_4P-L3.5-W2.8-BR-1]  264.62 34.02 191.3 top
LED374  -  [LED-SMD_4P-L3.5-W2.8-BR-1]  249.91 31.09 191.3 top
LED375  -  [LED-SMD_4P-L3.5-W2.8-BR-1]  235.2 28.16 191.3 top
LED376  -  [LED-SMD_4P-L3.5-W2.8-BR-1]  220.49 25.23 191.3 top
LED377  -  [LED-SMD_4P-L3.5-W2.8-BR-1]  318.31 55.69 191.3 top
LED378  -  [LED-SMD_4P-L3.5-W2.8-BR-1]  306.8 52.63 191.3 top
LED379  -  [LED-SMD_4P-L3.5-W2.8-BR-1]  292.09 49.7 191.3 top
LED380  -  [LED-SMD_4P-L3.5-W2.8-BR-1]  277.38 46.76 191.3 top
LED381  -  [LED-SMD_4P-L3.5-W2.8-BR-1]  268.69 45.13 11.3 top
LED382  -  [LED-SMD_4P-L3.5-W2.8-BR-1]  247.96 40.9 191.3 top
LED383  -  [LED-SMD_4P-L3.5-W2.8-BR-1]  233.25 37.97 191.3 top
LED384  -  [LED-SMD_4P-L3.5-W2.8-BR-1]  218.54 35.03 191.3 top
LED385  -  [LED-SMD_4P-L3.5-W2.8-BR-1]  205.7 14.08 180 top
LED386  -  [LED-SMD_4P-L3.5-W2.8-BR-1]  193.29 14.08 180 top
LED387  -  [LED-SMD_4P-L3.5-W2.8-BR-1]  178.29 14.08 180 top
LED388  -  [LED-SMD_4P-L3.5-W2.8-BR-1]  165.71 14.08 180 top
LED389  -  [LED-SMD_4P-L3.5-W2.8-BR-1]  205.7 24.08 180 top
LED390  -  [LED-SMD_4P-L3.5-W2.8-BR-1]  193.29 24.08 180 top
LED391  -  [LED-SMD_4P-L3.5-W2.8-BR-1]  178.29 24.08 180 top
LED392  -  [LED-SMD_4P-L3.5-W2.8-BR-1]  165.71 24.08 180 top
LED393  -  [LED-SMD_4P-L3.5-W2.8-BR-1]  205.7 34.08 180 top
LED394  -  [LED-SMD_4P-L3.5-W2.8-BR-1]  193.29 34.08 180 top
LED395  -  [LED-SMD_4P-L3.5-W2.8-BR-1]  178.29 34.08 180 top
LED396  -  [LED-SMD_4P-L3.5-W2.8-BR-1]  165.71 34.08 180 top
LED397  -  [LED-SMD_4P-L3.5-W2.8-BR-1]  146.69 15.93 168 top
LED398  -  [LED-SMD_4P-L3.5-W2.8-BR-1]  132.01 19.04 168 top
LED399  -  [LED-SMD_4P-L3.5-W2.8-BR-1]  117.34 22.16 168 top
LED400  -  [LED-SMD_4P-L3.5-W2.8-BR-1]  102.67 25.27 168 top
LED401  -  [LED-SMD_4P-L3.5-W2.8-BR-1]  88 28.39 168 top
LED402  -  [LED-SMD_4P-L3.5-W2.8-BR-1]  73.32 31.5 168 top
LED403  -  [LED-SMD_4P-L3.5-W2.8-BR-1]  58.65 34.62 168 top
LED404  -  [LED-SMD_4P-L3.5-W2.8-BR-1]  33.33 40.58 168 top
LED405  -  [LED-SMD_4P-L3.5-W2.8-BR-1]  148.76 25.71 168 top
LED406  -  [LED-SMD_4P-L3.5-W2.8-BR-1]  134.09 28.82 168 top
LED407  -  [LED-SMD_4P-L3.5-W2.8-BR-1]  119.42 31.94 168 top
LED408  -  [LED-SMD_4P-L3.5-W2.8-BR-1]  104.75 35.05 168 top
LED409  -  [LED-SMD_4P-L3.5-W2.8-BR-1]  90.07 38.17 168 top
LED410  -  [LED-SMD_4P-L3.5-W2.8-BR-1]  75.4 41.29 168 top
LED411  -  [LED-SMD_4P-L3.5-W2.8-BR-1]  60.73 44.4 168 top
LED412  -  [LED-SMD_4P-L3.5-W2.8-BR-1]  41.9 48.4 168 top
LED413  -  [LED-SMD_4P-L3.5-W2.8-BR-1]  150.84 35.49 168 top
LED414  -  [LED-SMD_4P-L3.5-W2.8-BR-1]  136.17 38.6 168 top
LED415  -  [LED-SMD_4P-L3.5-W2.8-BR-1]  121.5 41.72 168 top
LED416  -  [LED-SMD_4P-L3.5-W2.8-BR-1]  102.46 46.18 168 top
LED417  -  [LED-SMD_4P-L3.5-W2.8-BR-1]  92.15 47.95 168 top
LED418  -  [LED-SMD_4P-L3.5-W2.8-BR-1]  77.48 51.07 168 top
LED419  -  [LED-SMD_4P-L3.5-W2.8-BR-1]  62.8 54.18 168 top
LED420  -  [LED-SMD_4P-L3.5-W2.8-BR-1]  48.13 57.3 168 top
LED421  -  [LED-SMD_4P-L3.5-W2.8-BR-1]  15.82 66.66 87.4 top
LED422  -  [LED-SMD_4P-L3.5-W2.8-BR-1]  16.51 81.65 87.4 top
LED423  -  [LED-SMD_4P-L3.5-W2.8-BR-1]  17.19 96.63 87.4 top
LED424  -  [LED-SMD_4P-L3.5-W2.8-BR-1]  17.87 111.62 87.4 top
LED425  -  [LED-SMD_4P-L3.5-W2.8-BR-1]  18.56 126.6 87.4 top
LED426  -  [LED-SMD_4P-L3.5-W2.8-BR-1]  19.24 141.58 87.4 top
LED427  -  [LED-SMD_4P-L3.5-W2.8-BR-1]  27.2 65.37 86.5 top
LED428  -  [LED-SMD_4P-L3.5-W2.8-BR-1]  39.62 67.64 107.1 top
LED429  -  [LED-SMD_4P-L3.5-W2.8-BR-1]  30.7 81.61 107.1 top
LED430  -  [LED-SMD_4P-L3.5-W2.8-BR-1]  30.25 94.49 107.1 top
LED431  NCD0603R1  [LED0603-RD_RED]  341.08 209.67 270 top
LED432  -  [LED-SMD_4P-L3.5-W2.8-BR-1]  50.69 77.81 108.9 top
LED433  -  [LED-SMD_4P-L3.5-W2.8-BR-1]  45.84 92 108.9 top
LED434  -  [LED-SMD_4P-L3.5-W2.8-BR-1]  40.98 106.19 108.9 top
LED435  -  [LED-SMD_4P-L3.5-W2.8-BR-1]  36.12 120.38 108.9 top
LED436  -  [LED-SMD_4P-L3.5-W2.8-BR-1]  31.26 134.57 108.9 top
LED437  -  [LED-SMD_4P-L3.5-W2.8-BR-1]  26.41 148.77 108.9 top
R1  10kΩ  [R0603]  31.69 215.9 270 top
R2  10kΩ  [R0603]  351.59 236.44 90 top
R3  10kΩ  [R0603]  352.32 229.43 180 top
R4  1kΩ  [R0603]  353.04 236.44 270 top
R5  10kΩ  [R0603]  329.68 230.93 180 top
R6  3.3kΩ  [R0603]  30.87 218.06 0 top
R7  1kΩ  [R0603]  352.33 230.74 0 top
R8  10kΩ  [R0603]  326.56 229.36 180 top
R9  1kΩ  [R0603]  279.19 246.56 180 top
R10  1kΩ  [R0603]  285.25 225.77 0 top
R11  10kΩ  [R0603]  329.67 229.47 180 top
R12  10kΩ  [R0603]  326.57 227.86 180 top
R13  1kΩ  [R0603]  246.38 241.33 0 top
R14  10kΩ  [R0603]  338.91 215.43 0 top
R15  10kΩ  [R0603]  339.64 186.14 180 top
R16  1kΩ  [R0603]  243.57 235.6 0 top
R17  10kΩ  [R0603]  339.82 211.54 270 top
R18  10kΩ  [R0603]  329.65 232.49 0 top
R19  1kΩ  [R0603]  225.71 218.27 0 top
R20  10kΩ  [R0603]  333.56 193.3 180 top
R21  1kΩ  [R0603]  213.45 208.25 0 top
R22  10kΩ  [R0603]  329.71 192.6 90 top
R23  10kΩ  [R0603]  340.76 201.69 180 top
R24  10kΩ  [R0603]  336.15 190.04 180 top
R25  10kΩ  [R0603]  329.59 221.1 180 top
R26  10kΩ  [R0603]  336.03 215.47 180 top
R27  1kΩ  [R0603]  212.49 185.68 0 top
R28  10kΩ  [R0603]  333.09 215.47 0 top
R29  1kΩ  [R0603]  188.13 186.69 180 top
R30  1kΩ  [R0603]  338.93 208.84 180 top
R31  10kΩ  [R0603]  344.57 191.28 180 top
R32  5.1kΩ  [R0603]  348.91 202.21 0 top
R33  5.1kΩ  [R0603]  348.64 213.66 0 top
SW1  TS-1101-C-W  [SW-SMD_L6.0-W3.3-LS8.0]  331.21 248.65 90 top
SW2  TS-1101-C-W  [SW-SMD_L6.0-W3.3-LS8.0]  336.29 248.68 90 top
